# EasyEDA Pro project 效果器12-18.eprj, schematic Schematic1

## Sheets
1 stm32部分: Create Date: 2023-12-18; Page Name: stm32部分; Project Name: 效果器12-18; Schematic Name: Schematic1; Update Date: 2024-01-31; Company: 嘉立创EDA; Page Size: A4; Version: V1.0
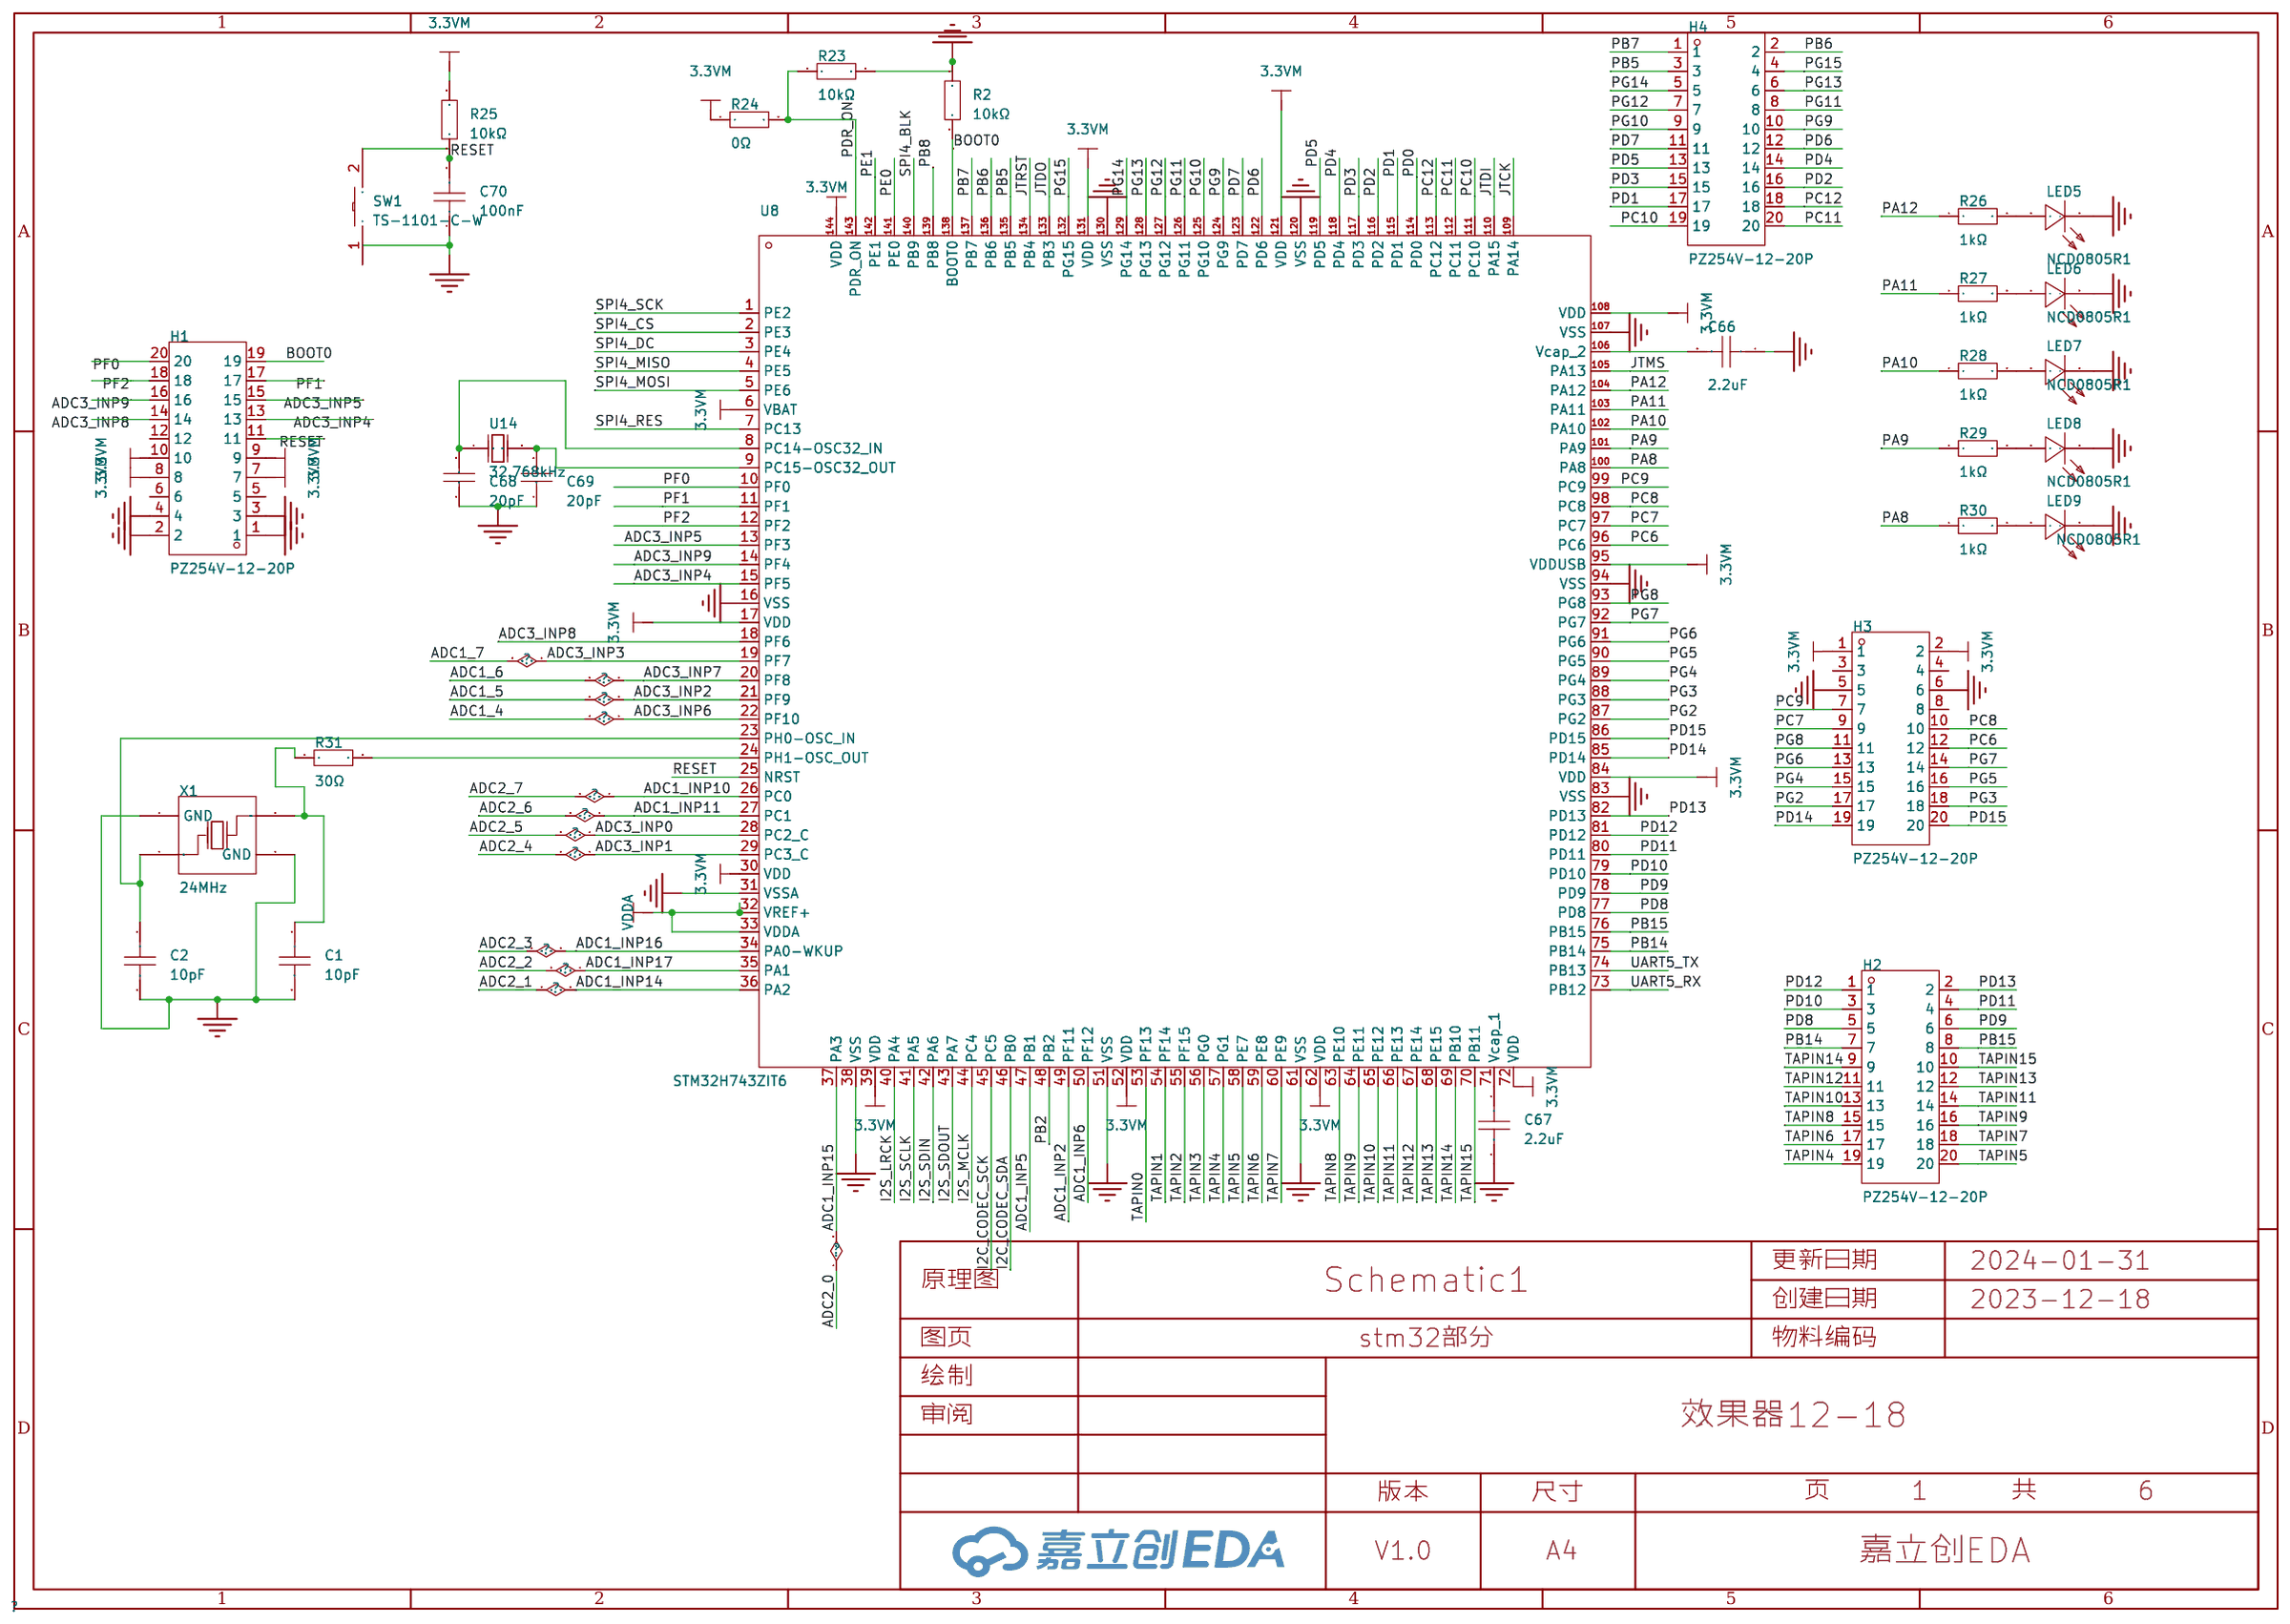
[diagram p0: stm32部分]
2 音频外设: Page Name: 音频外设
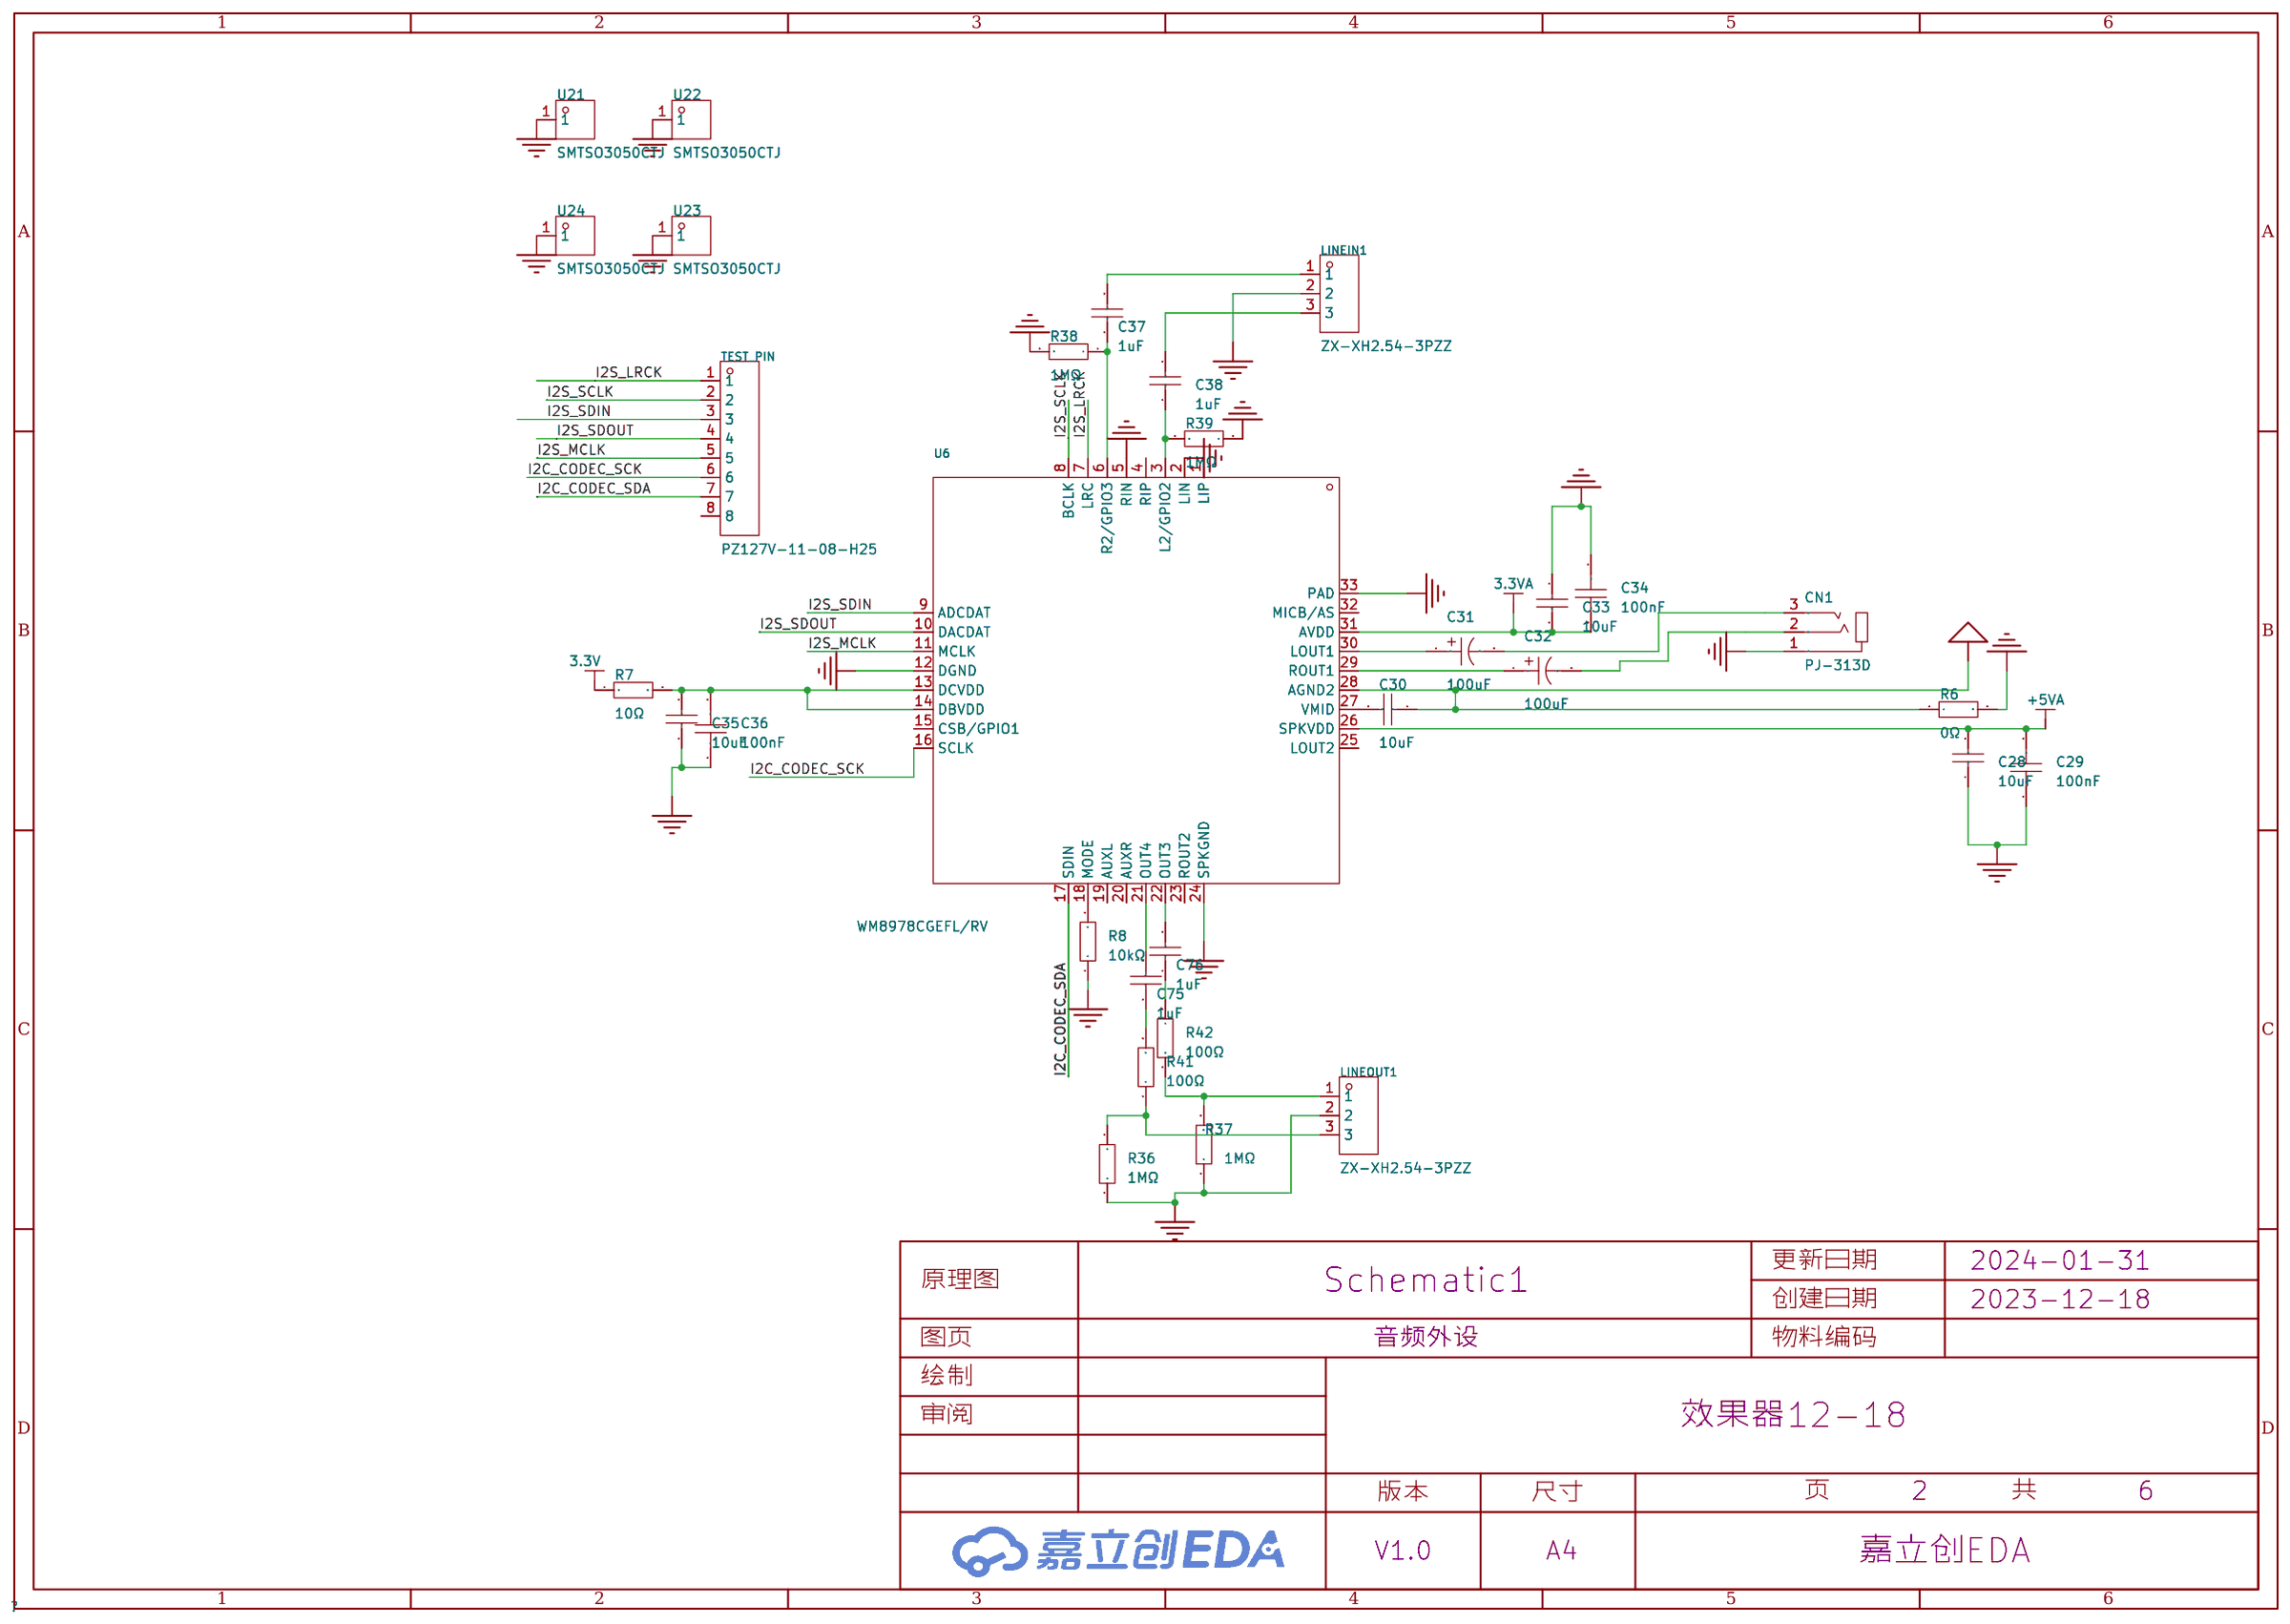
[diagram p1: 音频外设]
3 外部sram: Page Name: 外部sram; Update Date: 2024-01-08
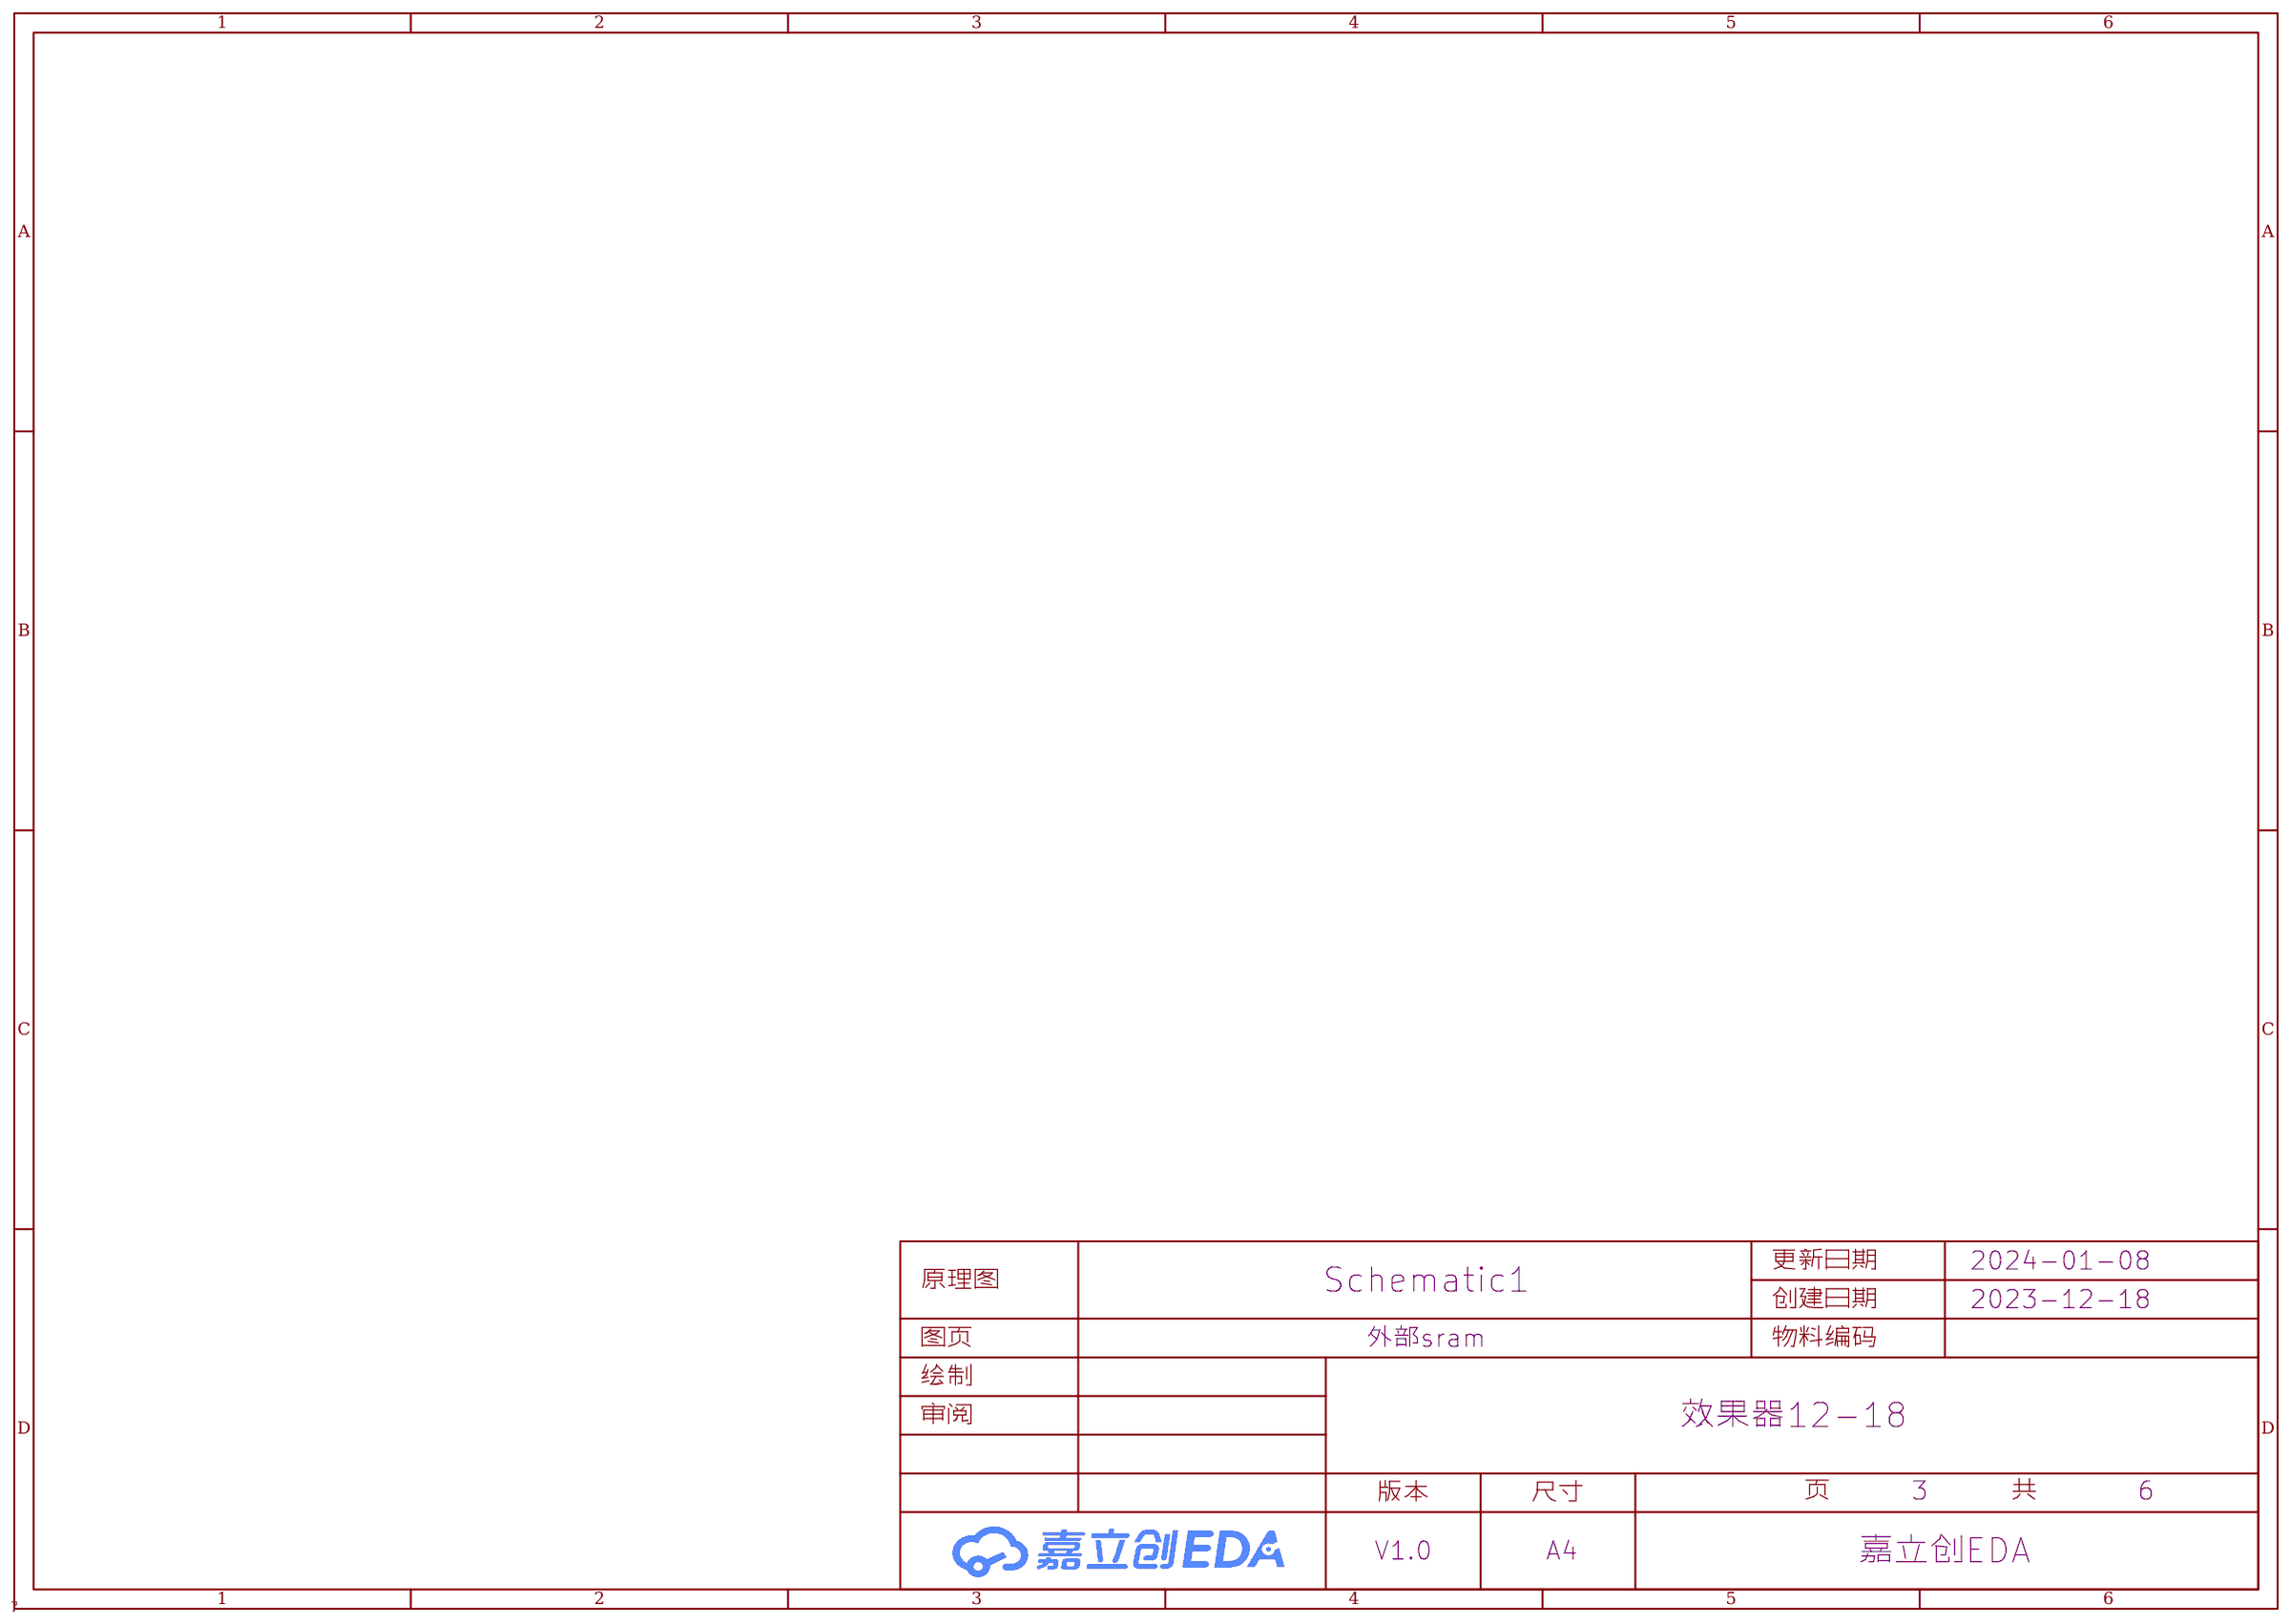
[diagram p2: 外部sram]
4 电源: Page Name: 电源; Update Date: 2023-12-27